# EasyEDA Pro project wukong01-Y003-HTOL.eprj, board PCB1
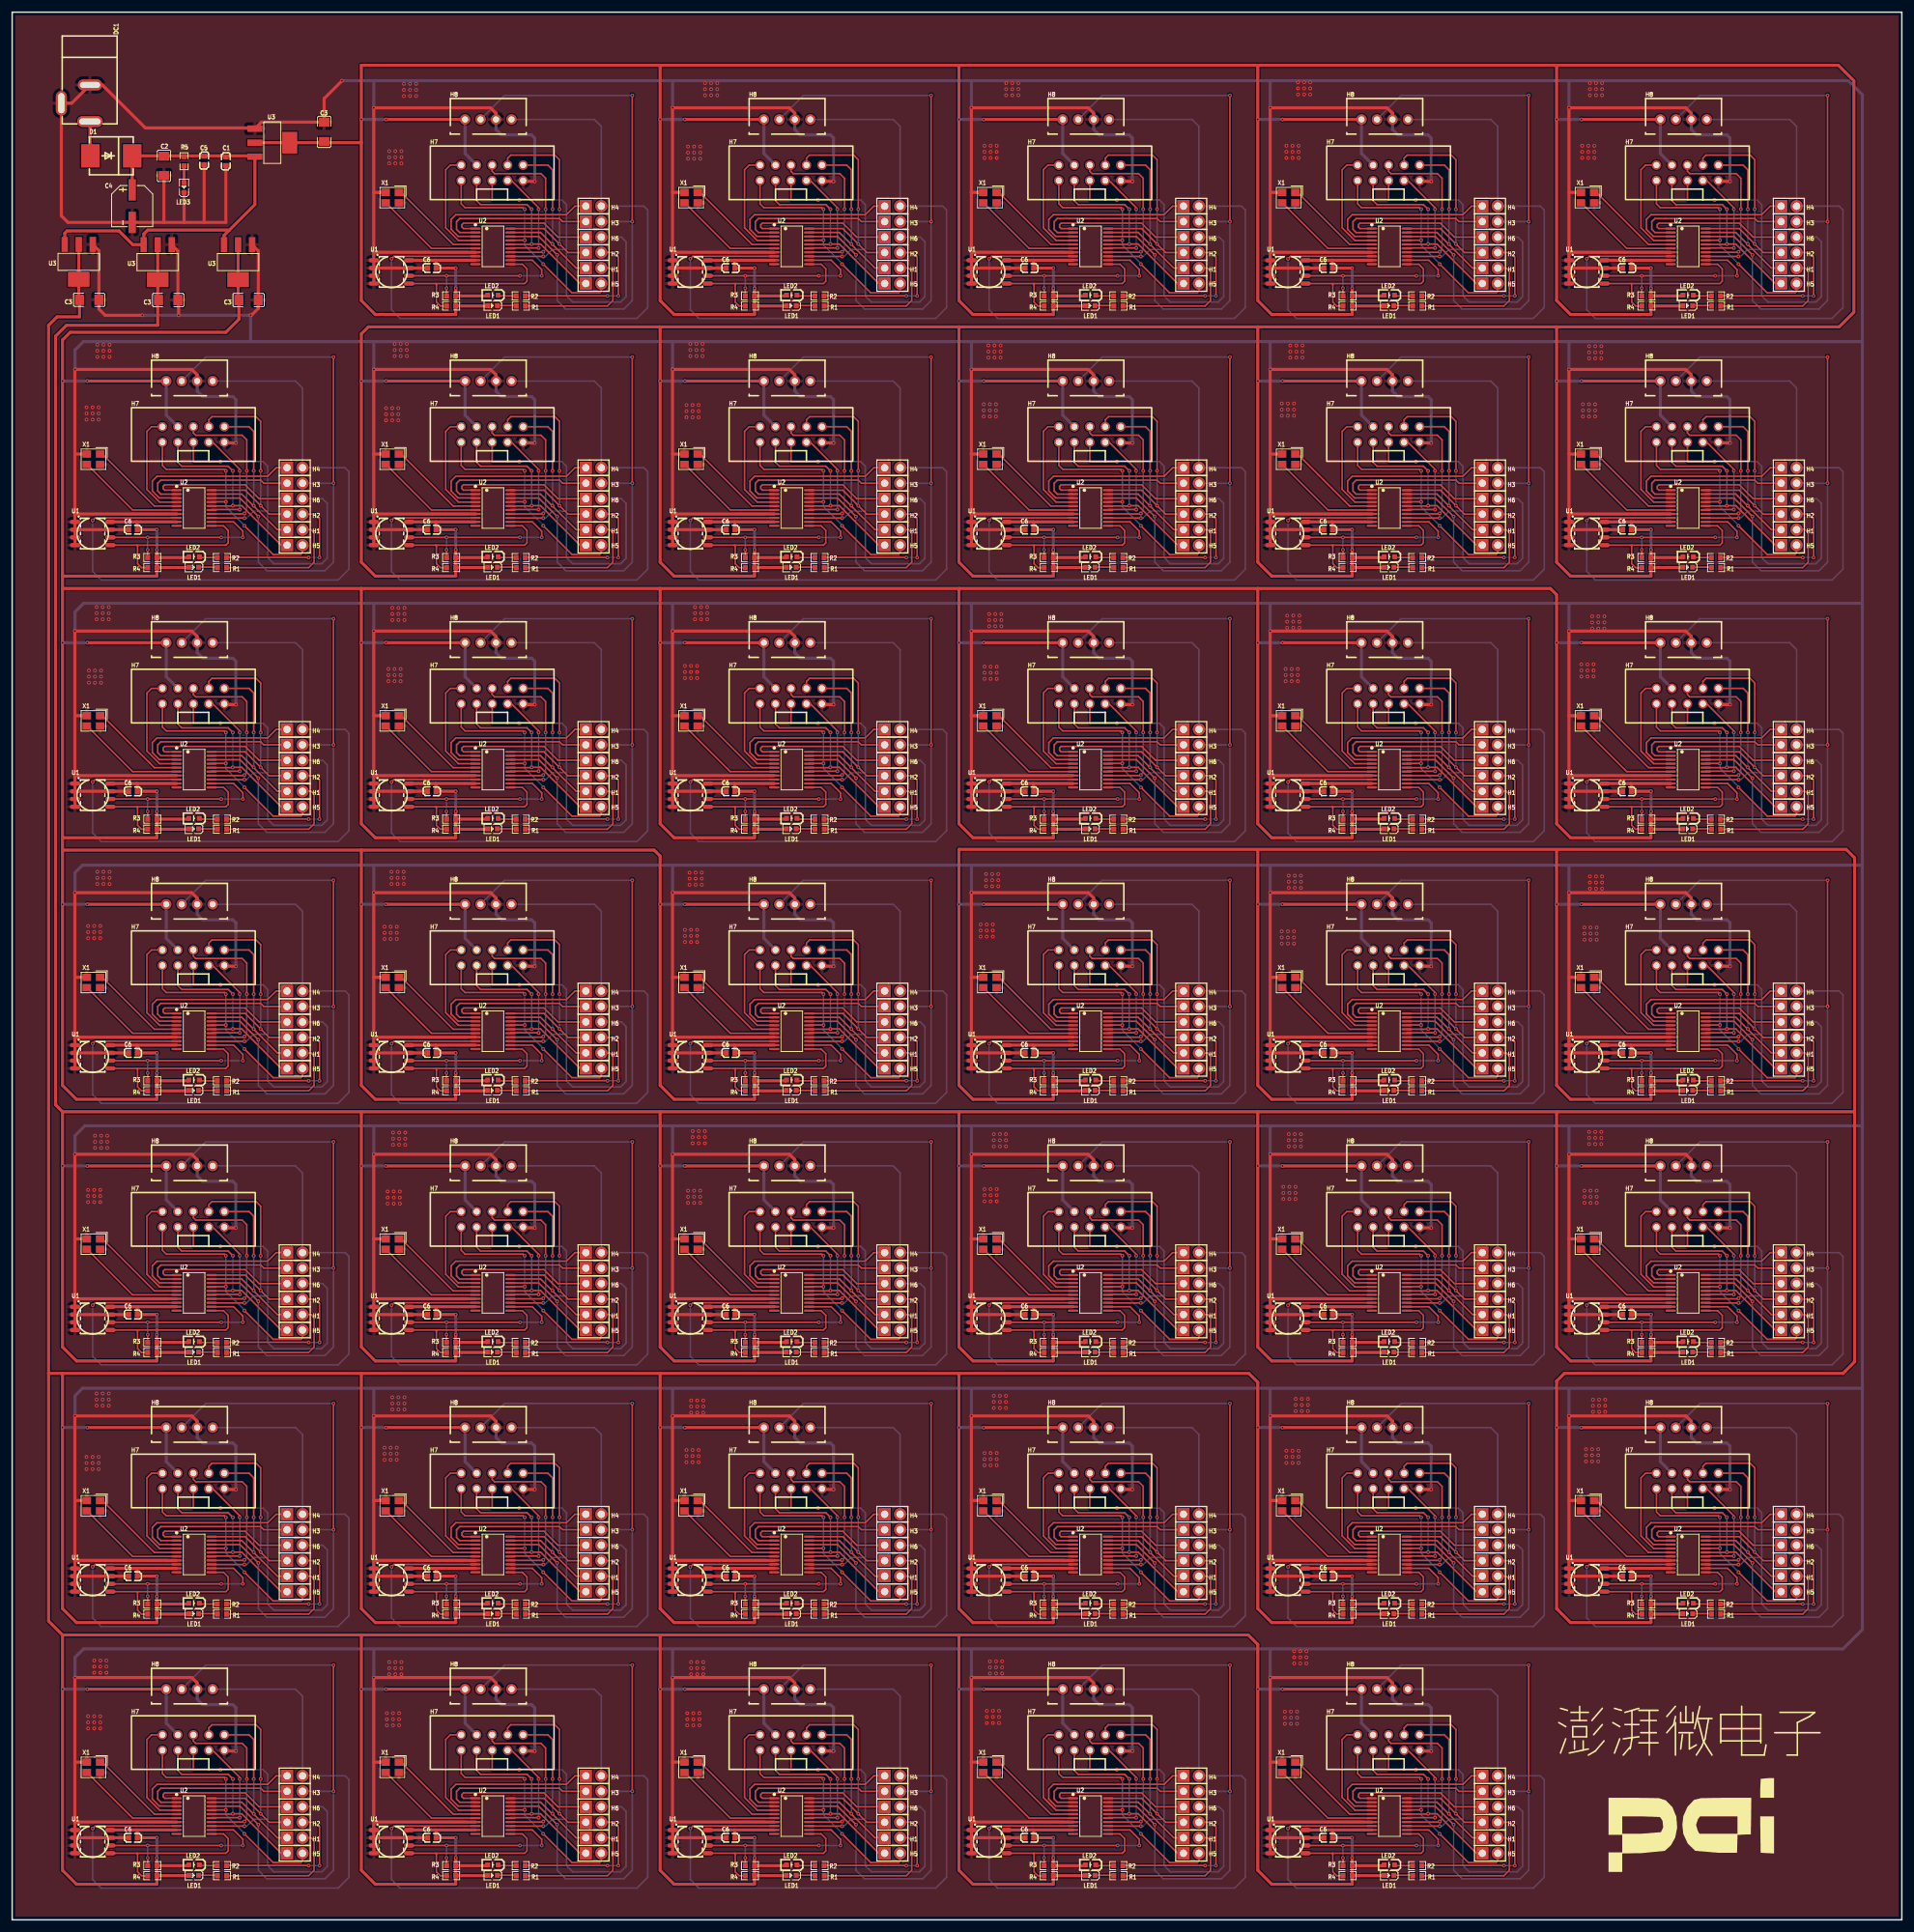
[diagram p1: board, top side]
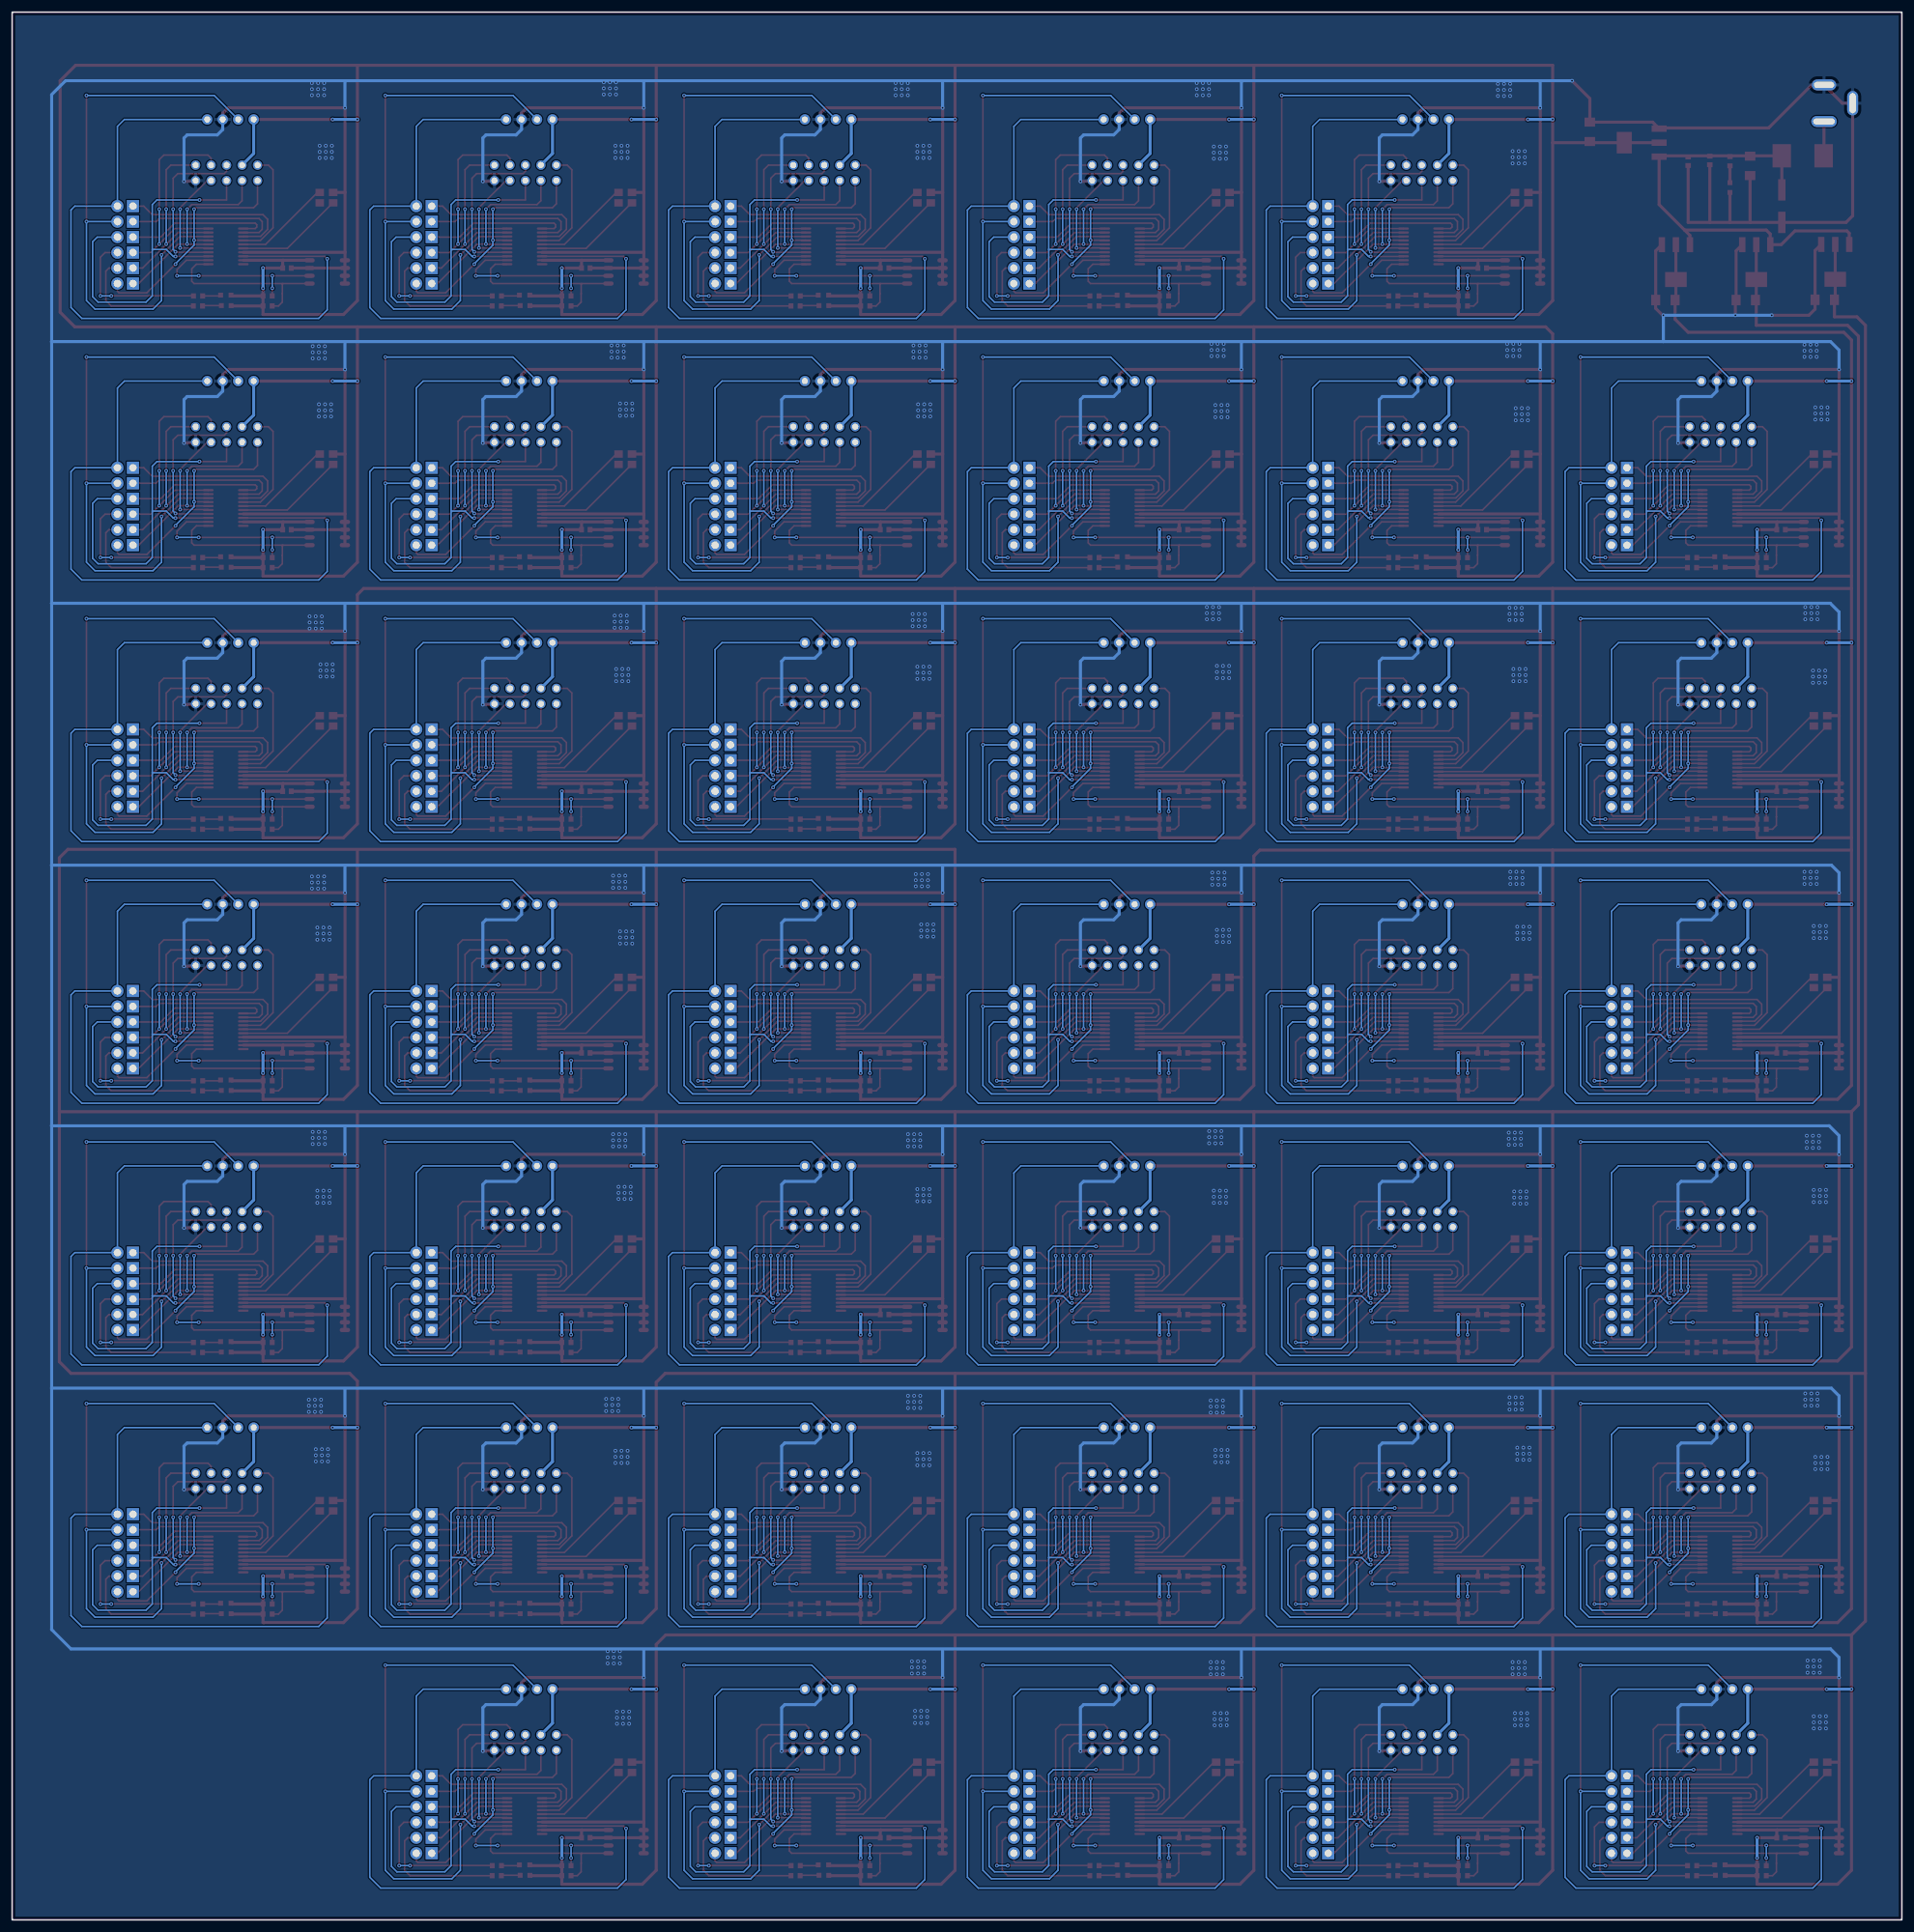
[diagram p2: board, bottom side, seen from below]

Outline 310 x 313 mm; copper layers: Top Layer, Bottom Layer. Coordinates in mm from the lower left corner of the outline.
Outline path: rectangle 0,313 310,0
Stack: Top Layer 0.035mm / Dielectric1 1.51mm FR4 er 4.5 / Bottom Layer 0.035mm

## Design rules (mm)
template: 自定义配置
spacing copperThickness1oz (default): track to track 0.102, other pairs 0.152 to 0.3
spacing copperThickness2oz: track to track 0.203, other pairs 0.152 to 0.3
track width copperThickness1oz (default): min 0.127, default 0.254, max 2.54
track width copperThickness2oz: min 0.203, default 0.254, max 2.54
differential pair differentialPair (default): width min 0.127, default 0.254, max 2.54; gap min 0.152, default 0.152
via viaSize (default): diameter min 0.5, default 0.61, max 10; hole min 0.3, default 0.305, max 6.299

## Placement (name value [footprint] x y rotation side)
C1  100nF  [C0603]  35.05 288.54 90 top
C2  10uF  [C1206]  24.89 287.78 270 top
C3  10uF  [C1206]  12.64 265.81 180 top
C3#2  -  [C1206]  25.6 265.77 180 top
C3#3  -  [C1206]  38.78 265.77 180 top
C3#4  -  [C1206]  51.18 293.37 270 top
C4  100uF  [CAP-SMD_BD6.3-L6.6-W6.6-LS7.6-FD-1]  19.69 281.18 270 top
C5  100nF  [C0603]  31.5 288.67 90 top
C6  100nF  [C0603]  19.81 142.24 0 top
C6#2  -  [C0603]  117.86 99.31 0 top
C6#3  -  [C0603]  68.83 99.31 0 top
C6#4  -  [C0603]  166.88 99.31 0 top
C6#5  -  [C0603]  264.92 99.31 0 top
C6#6  -  [C0603]  215.9 99.31 0 top
C6#7  -  [C0603]  19.81 99.31 0 top
C6#8  -  [C0603]  68.83 271.02 0 top
C6#9  -  [C0603]  166.88 271.02 0 top
C6#10  -  [C0603]  117.86 271.02 0 top
C6#11  -  [C0603]  264.92 271.02 0 top
C6#12  -  [C0603]  215.9 271.02 0 top
C6#13  -  [C0603]  117.86 56.39 0 top
C6#14  -  [C0603]  117.86 13.46 0 top
C6#15  -  [C0603]  264.92 56.39 0 top
C6#16  -  [C0603]  19.81 56.39 0 top
C6#17  -  [C0603]  19.81 13.46 0 top
C6#18  -  [C0603]  68.83 56.39 0 top
C6#19  -  [C0603]  166.88 13.46 0 top
C6#20  -  [C0603]  68.83 13.46 0 top
C6#21  -  [C0603]  166.88 56.39 0 top
C6#22  -  [C0603]  215.9 13.46 0 top
C6#23  -  [C0603]  215.9 56.39 0 top
C6#24  -  [C0603]  117.86 228.09 0 top
C6#25  -  [C0603]  68.83 228.09 0 top
C6#26  -  [C0603]  166.88 228.09 0 top
C6#27  -  [C0603]  264.92 228.09 0 top
C6#28  -  [C0603]  215.9 228.09 0 top
C6#29  -  [C0603]  19.81 228.09 0 top
C6#30  -  [C0603]  117.86 185.17 0 top
C6#31  -  [C0603]  68.83 185.17 0 top
C6#32  -  [C0603]  166.88 185.17 0 top
C6#33  -  [C0603]  264.92 185.17 0 top
C6#34  -  [C0603]  215.9 185.17 0 top
C6#35  -  [C0603]  19.81 185.17 0 top
C6#36  -  [C0603]  117.86 142.24 0 top
C6#37  -  [C0603]  68.83 142.24 0 top
C6#38  -  [C0603]  166.88 142.24 0 top
C6#39  -  [C0603]  264.92 142.24 0 top
C6#40  -  [C0603]  215.9 142.24 0 top
D1  SS36-E3/57T  [SMC_L7.1-W6.2-LS8.1-R-RD]  16.26 289.43 180 top
DC1  DC-005-5A-2.0  [DC-IN-TH_DC-005-5A-2.0]  10.41 298.07 270 top
H1  PZ254V-11-02P  [HDR-TH_2P-P2.54-V-M]  46.35 142.24 0 top
H1#2  -  [HDR-TH_2P-P2.54-V-M]  144.4 142.24 0 top
H1#3  -  [HDR-TH_2P-P2.54-V-M]  291.47 142.24 0 top
H1#4  -  [HDR-TH_2P-P2.54-V-M]  193.42 99.31 0 top
H1#5  -  [HDR-TH_2P-P2.54-V-M]  95.38 99.31 0 top
H1#6  -  [HDR-TH_2P-P2.54-V-M]  242.44 99.31 0 top
H1#7  -  [HDR-TH_2P-P2.54-V-M]  46.35 99.31 0 top
H1#8  -  [HDR-TH_2P-P2.54-V-M]  144.4 99.31 0 top
H1#9  -  [HDR-TH_2P-P2.54-V-M]  291.47 99.31 0 top
H1#10  -  [HDR-TH_2P-P2.54-V-M]  95.38 271.02 0 top
H1#11  -  [HDR-TH_2P-P2.54-V-M]  193.42 271.02 0 top
H1#12  -  [HDR-TH_2P-P2.54-V-M]  144.4 271.02 0 top
H1#13  -  [HDR-TH_2P-P2.54-V-M]  291.47 271.02 0 top
H1#14  -  [HDR-TH_2P-P2.54-V-M]  46.35 56.39 0 top
H1#15  -  [HDR-TH_2P-P2.54-V-M]  95.38 56.39 0 top
H1#16  -  [HDR-TH_2P-P2.54-V-M]  242.44 271.02 0 top
H1#17  -  [HDR-TH_2P-P2.54-V-M]  193.42 56.39 0 top
H1#18  -  [HDR-TH_2P-P2.54-V-M]  193.42 13.46 0 top
H1#19  -  [HDR-TH_2P-P2.54-V-M]  242.44 56.39 0 top
H1#20  -  [HDR-TH_2P-P2.54-V-M]  95.38 13.46 0 top
H1#21  -  [HDR-TH_2P-P2.54-V-M]  242.44 13.46 0 top
H1#22  -  [HDR-TH_2P-P2.54-V-M]  291.47 56.39 0 top
H1#23  -  [HDR-TH_2P-P2.54-V-M]  46.35 13.46 0 top
H1#24  -  [HDR-TH_2P-P2.54-V-M]  144.4 56.39 0 top
H1#25  -  [HDR-TH_2P-P2.54-V-M]  144.4 13.46 0 top
H1#26  -  [HDR-TH_2P-P2.54-V-M]  193.42 228.09 0 top
H1#27  -  [HDR-TH_2P-P2.54-V-M]  95.38 228.09 0 top
H1#28  -  [HDR-TH_2P-P2.54-V-M]  242.44 228.09 0 top
H1#29  -  [HDR-TH_2P-P2.54-V-M]  46.35 228.09 0 top
H1#30  -  [HDR-TH_2P-P2.54-V-M]  144.4 228.09 0 top
H1#31  -  [HDR-TH_2P-P2.54-V-M]  291.47 228.09 0 top
H1#32  -  [HDR-TH_2P-P2.54-V-M]  193.42 185.17 0 top
H1#33  -  [HDR-TH_2P-P2.54-V-M]  95.38 185.17 0 top
H1#34  -  [HDR-TH_2P-P2.54-V-M]  242.44 185.17 0 top
H1#35  -  [HDR-TH_2P-P2.54-V-M]  46.35 185.17 0 top
H1#36  -  [HDR-TH_2P-P2.54-V-M]  144.4 185.17 0 top
H1#37  -  [HDR-TH_2P-P2.54-V-M]  291.47 185.17 0 top
H1#38  -  [HDR-TH_2P-P2.54-V-M]  193.42 142.24 0 top
H1#39  -  [HDR-TH_2P-P2.54-V-M]  95.38 142.24 0 top
H1#40  -  [HDR-TH_2P-P2.54-V-M]  242.44 142.24 0 top
H2  PZ254V-11-02P  [HDR-TH_2P-P2.54-V-M]  144.4 144.78 0 top
H2#2  -  [HDR-TH_2P-P2.54-V-M]  291.47 144.78 0 top
H2#3  -  [HDR-TH_2P-P2.54-V-M]  193.42 101.85 0 top
H2#4  -  [HDR-TH_2P-P2.54-V-M]  242.44 101.85 0 top
H2#5  -  [HDR-TH_2P-P2.54-V-M]  95.38 101.85 0 top
H2#6  -  [HDR-TH_2P-P2.54-V-M]  46.35 101.85 0 top
H2#7  -  [HDR-TH_2P-P2.54-V-M]  144.4 101.85 0 top
H2#8  -  [HDR-TH_2P-P2.54-V-M]  291.47 101.85 0 top
H2#9  -  [HDR-TH_2P-P2.54-V-M]  95.38 273.56 0 top
H2#10  -  [HDR-TH_2P-P2.54-V-M]  193.42 273.56 0 top
H2#11  -  [HDR-TH_2P-P2.54-V-M]  144.4 273.56 0 top
H2#12  -  [HDR-TH_2P-P2.54-V-M]  291.47 273.56 0 top
H2#13  -  [HDR-TH_2P-P2.54-V-M]  46.35 58.93 0 top
H2#14  -  [HDR-TH_2P-P2.54-V-M]  242.44 273.56 0 top
H2#15  -  [HDR-TH_2P-P2.54-V-M]  193.42 58.93 0 top
H2#16  -  [HDR-TH_2P-P2.54-V-M]  193.42 16 0 top
H2#17  -  [HDR-TH_2P-P2.54-V-M]  242.44 58.93 0 top
H2#18  -  [HDR-TH_2P-P2.54-V-M]  95.38 58.93 0 top
H2#19  -  [HDR-TH_2P-P2.54-V-M]  144.4 16 0 top
H2#20  -  [HDR-TH_2P-P2.54-V-M]  46.35 16 0 top
H2#21  -  [HDR-TH_2P-P2.54-V-M]  144.4 58.93 0 top
H2#22  -  [HDR-TH_2P-P2.54-V-M]  242.44 16 0 top
H2#23  -  [HDR-TH_2P-P2.54-V-M]  291.47 58.93 0 top
H2#24  -  [HDR-TH_2P-P2.54-V-M]  95.38 16 0 top
H2#25  -  [HDR-TH_2P-P2.54-V-M]  193.42 230.63 0 top
H2#26  -  [HDR-TH_2P-P2.54-V-M]  242.44 230.63 0 top
H2#27  -  [HDR-TH_2P-P2.54-V-M]  95.38 230.63 0 top
H2#28  -  [HDR-TH_2P-P2.54-V-M]  46.35 230.63 0 top
H2#29  -  [HDR-TH_2P-P2.54-V-M]  144.4 230.63 0 top
H2#30  -  [HDR-TH_2P-P2.54-V-M]  291.47 230.63 0 top
H2#31  -  [HDR-TH_2P-P2.54-V-M]  193.42 187.71 0 top
H2#32  -  [HDR-TH_2P-P2.54-V-M]  242.44 187.71 0 top
H2#33  -  [HDR-TH_2P-P2.54-V-M]  95.38 187.71 0 top
H2#34  -  [HDR-TH_2P-P2.54-V-M]  46.35 187.71 0 top
H2#35  -  [HDR-TH_2P-P2.54-V-M]  144.4 187.71 0 top
H2#36  -  [HDR-TH_2P-P2.54-V-M]  291.47 187.71 0 top
H2#37  -  [HDR-TH_2P-P2.54-V-M]  193.42 144.78 0 top
H2#38  -  [HDR-TH_2P-P2.54-V-M]  242.44 144.78 0 top
H2#39  -  [HDR-TH_2P-P2.54-V-M]  95.38 144.78 0 top
H2#40  -  [HDR-TH_2P-P2.54-V-M]  46.35 144.78 0 top
H3  PZ254V-11-02P  [HDR-TH_2P-P2.54-V-M]  291.47 149.86 0 top
H3#2  -  [HDR-TH_2P-P2.54-V-M]  193.42 106.93 0 top
H3#3  -  [HDR-TH_2P-P2.54-V-M]  144.4 106.93 0 top
H3#4  -  [HDR-TH_2P-P2.54-V-M]  95.38 106.93 0 top
H3#5  -  [HDR-TH_2P-P2.54-V-M]  46.35 106.93 0 top
H3#6  -  [HDR-TH_2P-P2.54-V-M]  242.44 106.93 0 top
H3#7  -  [HDR-TH_2P-P2.54-V-M]  291.47 106.93 0 top
H3#8  -  [HDR-TH_2P-P2.54-V-M]  95.38 278.64 0 top
H3#9  -  [HDR-TH_2P-P2.54-V-M]  193.42 278.64 0 top
H3#10  -  [HDR-TH_2P-P2.54-V-M]  144.4 278.64 0 top
H3#11  -  [HDR-TH_2P-P2.54-V-M]  291.47 278.64 0 top
H3#12  -  [HDR-TH_2P-P2.54-V-M]  242.44 278.64 0 top
H3#13  -  [HDR-TH_2P-P2.54-V-M]  46.35 64.01 0 top
H3#14  -  [HDR-TH_2P-P2.54-V-M]  144.4 64.01 0 top
H3#15  -  [HDR-TH_2P-P2.54-V-M]  193.42 64.01 0 top
H3#16  -  [HDR-TH_2P-P2.54-V-M]  193.42 21.08 0 top
H3#17  -  [HDR-TH_2P-P2.54-V-M]  46.35 21.08 0 top
H3#18  -  [HDR-TH_2P-P2.54-V-M]  144.4 21.08 0 top
H3#19  -  [HDR-TH_2P-P2.54-V-M]  291.47 64.01 0 top
H3#20  -  [HDR-TH_2P-P2.54-V-M]  242.44 64.01 0 top
H3#21  -  [HDR-TH_2P-P2.54-V-M]  95.38 64.01 0 top
H3#22  -  [HDR-TH_2P-P2.54-V-M]  242.44 21.08 0 top
H3#23  -  [HDR-TH_2P-P2.54-V-M]  95.38 21.08 0 top
H3#24  -  [HDR-TH_2P-P2.54-V-M]  193.42 235.71 0 top
H3#25  -  [HDR-TH_2P-P2.54-V-M]  144.4 235.71 0 top
H3#26  -  [HDR-TH_2P-P2.54-V-M]  95.38 235.71 0 top
H3#27  -  [HDR-TH_2P-P2.54-V-M]  46.35 235.71 0 top
H3#28  -  [HDR-TH_2P-P2.54-V-M]  242.44 235.71 0 top
H3#29  -  [HDR-TH_2P-P2.54-V-M]  291.47 235.71 0 top
H3#30  -  [HDR-TH_2P-P2.54-V-M]  193.42 192.79 0 top
H3#31  -  [HDR-TH_2P-P2.54-V-M]  144.4 192.79 0 top
H3#32  -  [HDR-TH_2P-P2.54-V-M]  95.38 192.79 0 top
H3#33  -  [HDR-TH_2P-P2.54-V-M]  46.35 192.79 0 top
H3#34  -  [HDR-TH_2P-P2.54-V-M]  242.44 192.79 0 top
H3#35  -  [HDR-TH_2P-P2.54-V-M]  291.47 192.79 0 top
H3#36  -  [HDR-TH_2P-P2.54-V-M]  193.42 149.86 0 top
H3#37  -  [HDR-TH_2P-P2.54-V-M]  144.4 149.86 0 top
H3#38  -  [HDR-TH_2P-P2.54-V-M]  95.38 149.86 0 top
H3#39  -  [HDR-TH_2P-P2.54-V-M]  46.35 149.86 0 top
H3#40  -  [HDR-TH_2P-P2.54-V-M]  242.44 149.86 0 top
H4  PZ254V-11-02P  [HDR-TH_2P-P2.54-V-M]  193.42 109.47 0 top
H4#2  -  [HDR-TH_2P-P2.54-V-M]  95.38 109.47 0 top
H4#3  -  [HDR-TH_2P-P2.54-V-M]  144.4 109.47 0 top
H4#4  -  [HDR-TH_2P-P2.54-V-M]  242.44 109.47 0 top
H4#5  -  [HDR-TH_2P-P2.54-V-M]  46.35 109.47 0 top
H4#6  -  [HDR-TH_2P-P2.54-V-M]  291.47 109.47 0 top
H4#7  -  [HDR-TH_2P-P2.54-V-M]  95.38 281.18 0 top
H4#8  -  [HDR-TH_2P-P2.54-V-M]  193.42 281.18 0 top
H4#9  -  [HDR-TH_2P-P2.54-V-M]  144.4 281.18 0 top
H4#10  -  [HDR-TH_2P-P2.54-V-M]  291.47 281.18 0 top
H4#11  -  [HDR-TH_2P-P2.54-V-M]  242.44 281.18 0 top
H4#12  -  [HDR-TH_2P-P2.54-V-M]  193.42 66.55 0 top
H4#13  -  [HDR-TH_2P-P2.54-V-M]  46.35 66.55 0 top
H4#14  -  [HDR-TH_2P-P2.54-V-M]  46.35 23.62 0 top
H4#15  -  [HDR-TH_2P-P2.54-V-M]  95.38 66.55 0 top
H4#16  -  [HDR-TH_2P-P2.54-V-M]  144.4 66.55 0 top
H4#17  -  [HDR-TH_2P-P2.54-V-M]  193.42 23.62 0 top
H4#18  -  [HDR-TH_2P-P2.54-V-M]  291.47 66.55 0 top
H4#19  -  [HDR-TH_2P-P2.54-V-M]  242.44 66.55 0 top
H4#20  -  [HDR-TH_2P-P2.54-V-M]  95.38 23.62 0 top
H4#21  -  [HDR-TH_2P-P2.54-V-M]  242.44 23.62 0 top
H4#22  -  [HDR-TH_2P-P2.54-V-M]  144.4 23.62 0 top
H4#23  -  [HDR-TH_2P-P2.54-V-M]  193.42 238.25 0 top
H4#24  -  [HDR-TH_2P-P2.54-V-M]  95.38 238.25 0 top
H4#25  -  [HDR-TH_2P-P2.54-V-M]  144.4 238.25 0 top
H4#26  -  [HDR-TH_2P-P2.54-V-M]  242.44 238.25 0 top
H4#27  -  [HDR-TH_2P-P2.54-V-M]  46.35 238.25 0 top
H4#28  -  [HDR-TH_2P-P2.54-V-M]  291.47 238.25 0 top
H4#29  -  [HDR-TH_2P-P2.54-V-M]  193.42 195.33 0 top
H4#30  -  [HDR-TH_2P-P2.54-V-M]  95.38 195.33 0 top
H4#31  -  [HDR-TH_2P-P2.54-V-M]  144.4 195.33 0 top
H4#32  -  [HDR-TH_2P-P2.54-V-M]  242.44 195.33 0 top
H4#33  -  [HDR-TH_2P-P2.54-V-M]  46.35 195.33 0 top
H4#34  -  [HDR-TH_2P-P2.54-V-M]  291.47 195.33 0 top
H4#35  -  [HDR-TH_2P-P2.54-V-M]  193.42 152.4 0 top
H4#36  -  [HDR-TH_2P-P2.54-V-M]  95.38 152.4 0 top
H4#37  -  [HDR-TH_2P-P2.54-V-M]  144.4 152.4 0 top
H4#38  -  [HDR-TH_2P-P2.54-V-M]  242.44 152.4 0 top
H4#39  -  [HDR-TH_2P-P2.54-V-M]  46.35 152.4 0 top
H4#40  -  [HDR-TH_2P-P2.54-V-M]  291.47 152.4 0 top
H5  PZ254V-11-02P  [HDR-TH_2P-P2.54-V-M]  144.4 139.7 0 top
H5#2  -  [HDR-TH_2P-P2.54-V-M]  193.42 96.77 0 top
H5#3  -  [HDR-TH_2P-P2.54-V-M]  291.47 96.77 0 top
H5#4  -  [HDR-TH_2P-P2.54-V-M]  95.38 96.77 0 top
H5#5  -  [HDR-TH_2P-P2.54-V-M]  46.35 96.77 0 top
H5#6  -  [HDR-TH_2P-P2.54-V-M]  242.44 96.77 0 top
H5#7  -  [HDR-TH_2P-P2.54-V-M]  144.4 96.77 0 top
H5#8  -  [HDR-TH_2P-P2.54-V-M]  95.38 268.48 0 top
H5#9  -  [HDR-TH_2P-P2.54-V-M]  193.42 268.48 0 top
H5#10  -  [HDR-TH_2P-P2.54-V-M]  144.4 268.48 0 top
H5#11  -  [HDR-TH_2P-P2.54-V-M]  291.47 268.48 0 top
H5#12  -  [HDR-TH_2P-P2.54-V-M]  242.44 268.48 0 top
H5#13  -  [HDR-TH_2P-P2.54-V-M]  291.47 53.85 0 top
H5#14  -  [HDR-TH_2P-P2.54-V-M]  95.38 10.92 0 top
H5#15  -  [HDR-TH_2P-P2.54-V-M]  95.38 53.85 0 top
H5#16  -  [HDR-TH_2P-P2.54-V-M]  193.42 53.85 0 top
H5#17  -  [HDR-TH_2P-P2.54-V-M]  242.44 10.92 0 top
H5#18  -  [HDR-TH_2P-P2.54-V-M]  193.42 10.92 0 top
H5#19  -  [HDR-TH_2P-P2.54-V-M]  144.4 10.92 0 top
H5#20  -  [HDR-TH_2P-P2.54-V-M]  242.44 53.85 0 top
H5#21  -  [HDR-TH_2P-P2.54-V-M]  46.35 10.92 0 top
H5#22  -  [HDR-TH_2P-P2.54-V-M]  46.35 53.85 0 top
H5#23  -  [HDR-TH_2P-P2.54-V-M]  144.4 53.85 0 top
H5#24  -  [HDR-TH_2P-P2.54-V-M]  193.42 225.55 0 top
H5#25  -  [HDR-TH_2P-P2.54-V-M]  291.47 225.55 0 top
H5#26  -  [HDR-TH_2P-P2.54-V-M]  95.38 225.55 0 top
H5#27  -  [HDR-TH_2P-P2.54-V-M]  46.35 225.55 0 top
H5#28  -  [HDR-TH_2P-P2.54-V-M]  242.44 225.55 0 top
H5#29  -  [HDR-TH_2P-P2.54-V-M]  144.4 225.55 0 top
H5#30  -  [HDR-TH_2P-P2.54-V-M]  193.42 182.63 0 top
H5#31  -  [HDR-TH_2P-P2.54-V-M]  291.47 182.63 0 top
H5#32  -  [HDR-TH_2P-P2.54-V-M]  95.38 182.63 0 top
H5#33  -  [HDR-TH_2P-P2.54-V-M]  46.35 182.63 0 top
H5#34  -  [HDR-TH_2P-P2.54-V-M]  242.44 182.63 0 top
H5#35  -  [HDR-TH_2P-P2.54-V-M]  144.4 182.63 0 top
H5#36  -  [HDR-TH_2P-P2.54-V-M]  193.42 139.7 0 top
H5#37  -  [HDR-TH_2P-P2.54-V-M]  291.47 139.7 0 top
H5#38  -  [HDR-TH_2P-P2.54-V-M]  95.38 139.7 0 top
H5#39  -  [HDR-TH_2P-P2.54-V-M]  46.35 139.7 0 top
H5#40  -  [HDR-TH_2P-P2.54-V-M]  242.44 139.7 0 top
H6  PZ254V-11-02P  [HDR-TH_2P-P2.54-V-M]  291.47 147.32 0 top
H6#2  -  [HDR-TH_2P-P2.54-V-M]  193.42 104.39 0 top
H6#3  -  [HDR-TH_2P-P2.54-V-M]  144.4 104.39 0 top
H6#4  -  [HDR-TH_2P-P2.54-V-M]  95.38 104.39 0 top
H6#5  -  [HDR-TH_2P-P2.54-V-M]  46.35 104.39 0 top
H6#6  -  [HDR-TH_2P-P2.54-V-M]  242.44 104.39 0 top
H6#7  -  [HDR-TH_2P-P2.54-V-M]  291.47 104.39 0 top
H6#8  -  [HDR-TH_2P-P2.54-V-M]  95.38 276.1 0 top
H6#9  -  [HDR-TH_2P-P2.54-V-M]  193.42 276.1 0 top
H6#10  -  [HDR-TH_2P-P2.54-V-M]  144.4 276.1 0 top
H6#11  -  [HDR-TH_2P-P2.54-V-M]  291.47 276.1 0 top
H6#12  -  [HDR-TH_2P-P2.54-V-M]  242.44 276.1 0 top
H6#13  -  [HDR-TH_2P-P2.54-V-M]  46.35 61.47 0 top
H6#14  -  [HDR-TH_2P-P2.54-V-M]  144.4 61.47 0 top
H6#15  -  [HDR-TH_2P-P2.54-V-M]  193.42 61.47 0 top
H6#16  -  [HDR-TH_2P-P2.54-V-M]  193.42 18.54 0 top
H6#17  -  [HDR-TH_2P-P2.54-V-M]  46.35 18.54 0 top
H6#18  -  [HDR-TH_2P-P2.54-V-M]  95.38 61.47 0 top
H6#19  -  [HDR-TH_2P-P2.54-V-M]  144.4 18.54 0 top
H6#20  -  [HDR-TH_2P-P2.54-V-M]  242.44 61.47 0 top
H6#21  -  [HDR-TH_2P-P2.54-V-M]  242.44 18.54 0 top
H6#22  -  [HDR-TH_2P-P2.54-V-M]  291.47 61.47 0 top
H6#23  -  [HDR-TH_2P-P2.54-V-M]  95.38 18.54 0 top
H6#24  -  [HDR-TH_2P-P2.54-V-M]  193.42 233.17 0 top
H6#25  -  [HDR-TH_2P-P2.54-V-M]  144.4 233.17 0 top
H6#26  -  [HDR-TH_2P-P2.54-V-M]  95.38 233.17 0 top
H6#27  -  [HDR-TH_2P-P2.54-V-M]  46.35 233.17 0 top
H6#28  -  [HDR-TH_2P-P2.54-V-M]  242.44 233.17 0 top
H6#29  -  [HDR-TH_2P-P2.54-V-M]  291.47 233.17 0 top
H6#30  -  [HDR-TH_2P-P2.54-V-M]  193.42 190.25 0 top
H6#31  -  [HDR-TH_2P-P2.54-V-M]  144.4 190.25 0 top
H6#32  -  [HDR-TH_2P-P2.54-V-M]  95.38 190.25 0 top
H6#33  -  [HDR-TH_2P-P2.54-V-M]  46.35 190.25 0 top
H6#34  -  [HDR-TH_2P-P2.54-V-M]  242.44 190.25 0 top
H6#35  -  [HDR-TH_2P-P2.54-V-M]  291.47 190.25 0 top
H6#36  -  [HDR-TH_2P-P2.54-V-M]  193.42 147.32 0 top
H6#37  -  [HDR-TH_2P-P2.54-V-M]  144.4 147.32 0 top
H6#38  -  [HDR-TH_2P-P2.54-V-M]  95.38 147.32 0 top
H6#39  -  [HDR-TH_2P-P2.54-V-M]  46.35 147.32 0 top
H6#40  -  [HDR-TH_2P-P2.54-V-M]  242.44 147.32 0 top
H7  2.54-2*5P简牛  [IDC-TH_10P-P2.54_C5665]  127.76 114.94 0 top
H7#2  -  [IDC-TH_10P-P2.54_C5665]  78.74 114.94 0 top
H7#3  -  [IDC-TH_10P-P2.54_C5665]  176.78 114.94 0 top
H7#4  -  [IDC-TH_10P-P2.54_C5665]  274.83 114.94 0 top
H7#5  -  [IDC-TH_10P-P2.54_C5665]  225.81 114.94 0 top
H7#6  -  [IDC-TH_10P-P2.54_C5665]  29.72 114.94 0 top
H7#7  -  [IDC-TH_10P-P2.54_C5665]  78.74 286.64 0 top
H7#8  -  [IDC-TH_10P-P2.54_C5665]  176.78 286.64 0 top
H7#9  -  [IDC-TH_10P-P2.54_C5665]  127.76 286.64 0 top
H7#10  -  [IDC-TH_10P-P2.54_C5665]  274.83 286.64 0 top
H7#11  -  [IDC-TH_10P-P2.54_C5665]  29.72 29.08 0 top
H7#12  -  [IDC-TH_10P-P2.54_C5665]  29.72 72.01 0 top
H7#13  -  [IDC-TH_10P-P2.54_C5665]  274.83 72.01 0 top
H7#14  -  [IDC-TH_10P-P2.54_C5665]  225.81 286.64 0 top
H7#15  -  [IDC-TH_10P-P2.54_C5665]  78.74 72.01 0 top
H7#16  -  [IDC-TH_10P-P2.54_C5665]  176.78 72.01 0 top
H7#17  -  [IDC-TH_10P-P2.54_C5665]  127.76 72.01 0 top
H7#18  -  [IDC-TH_10P-P2.54_C5665]  225.81 29.08 0 top
H7#19  -  [IDC-TH_10P-P2.54_C5665]  78.74 29.08 0 top
H7#20  -  [IDC-TH_10P-P2.54_C5665]  127.76 29.08 0 top
H7#21  -  [IDC-TH_10P-P2.54_C5665]  176.78 29.08 0 top
H7#22  -  [IDC-TH_10P-P2.54_C5665]  225.81 72.01 0 top
H7#23  -  [IDC-TH_10P-P2.54_C5665]  127.76 243.71 0 top
H7#24  -  [IDC-TH_10P-P2.54_C5665]  78.74 243.71 0 top
H7#25  -  [IDC-TH_10P-P2.54_C5665]  176.78 243.71 0 top
H7#26  -  [IDC-TH_10P-P2.54_C5665]  274.83 243.71 0 top
H7#27  -  [IDC-TH_10P-P2.54_C5665]  225.81 243.71 0 top
H7#28  -  [IDC-TH_10P-P2.54_C5665]  29.72 243.71 0 top
H7#29  -  [IDC-TH_10P-P2.54_C5665]  127.76 200.79 0 top
H7#30  -  [IDC-TH_10P-P2.54_C5665]  78.74 200.79 0 top
H7#31  -  [IDC-TH_10P-P2.54_C5665]  176.78 200.79 0 top
H7#32  -  [IDC-TH_10P-P2.54_C5665]  274.83 200.79 0 top
H7#33  -  [IDC-TH_10P-P2.54_C5665]  225.81 200.79 0 top
H7#34  -  [IDC-TH_10P-P2.54_C5665]  29.72 200.79 0 top
H7#35  -  [IDC-TH_10P-P2.54_C5665]  127.76 157.86 0 top
H7#36  -  [IDC-TH_10P-P2.54_C5665]  78.74 157.86 0 top
H7#37  -  [IDC-TH_10P-P2.54_C5665]  176.78 157.86 0 top
H7#38  -  [IDC-TH_10P-P2.54_C5665]  274.83 157.86 0 top
H7#39  -  [IDC-TH_10P-P2.54_C5665]  225.81 157.86 0 top
H7#40  -  [IDC-TH_10P-P2.54_C5665]  29.72 157.86 0 top
H8  B4B-XH-A(LF)(SN)  [CONN-TH_B4B-XH-A-LF-SN]  78.11 123.7 0 top
H8#2  -  [CONN-TH_B4B-XH-A-LF-SN]  176.15 123.7 0 top
H8#3  -  [CONN-TH_B4B-XH-A-LF-SN]  127.13 123.7 0 top
H8#4  -  [CONN-TH_B4B-XH-A-LF-SN]  274.19 123.7 0 top
H8#5  -  [CONN-TH_B4B-XH-A-LF-SN]  225.17 123.7 0 top
H8#6  -  [CONN-TH_B4B-XH-A-LF-SN]  29.08 123.7 0 top
H8#7  -  [CONN-TH_B4B-XH-A-LF-SN]  78.11 295.4 0 top
H8#8  -  [CONN-TH_B4B-XH-A-LF-SN]  176.15 295.4 0 top
H8#9  -  [CONN-TH_B4B-XH-A-LF-SN]  127.13 295.4 0 top
H8#10  -  [CONN-TH_B4B-XH-A-LF-SN]  274.19 295.4 0 top
H8#11  -  [CONN-TH_B4B-XH-A-LF-SN]  29.08 80.77 0 top
H8#12  -  [CONN-TH_B4B-XH-A-LF-SN]  78.11 80.77 0 top
H8#13  -  [CONN-TH_B4B-XH-A-LF-SN]  176.15 80.77 0 top
H8#14  -  [CONN-TH_B4B-XH-A-LF-SN]  274.19 80.77 0 top
H8#15  -  [CONN-TH_B4B-XH-A-LF-SN]  225.17 295.4 0 top
H8#16  -  [CONN-TH_B4B-XH-A-LF-SN]  78.11 37.85 0 top
H8#17  -  [CONN-TH_B4B-XH-A-LF-SN]  29.08 37.85 0 top
H8#18  -  [CONN-TH_B4B-XH-A-LF-SN]  127.13 80.77 0 top